# EasyEDA Pro project 智能视觉母版_2024.eprj, board PCB1 (continued)
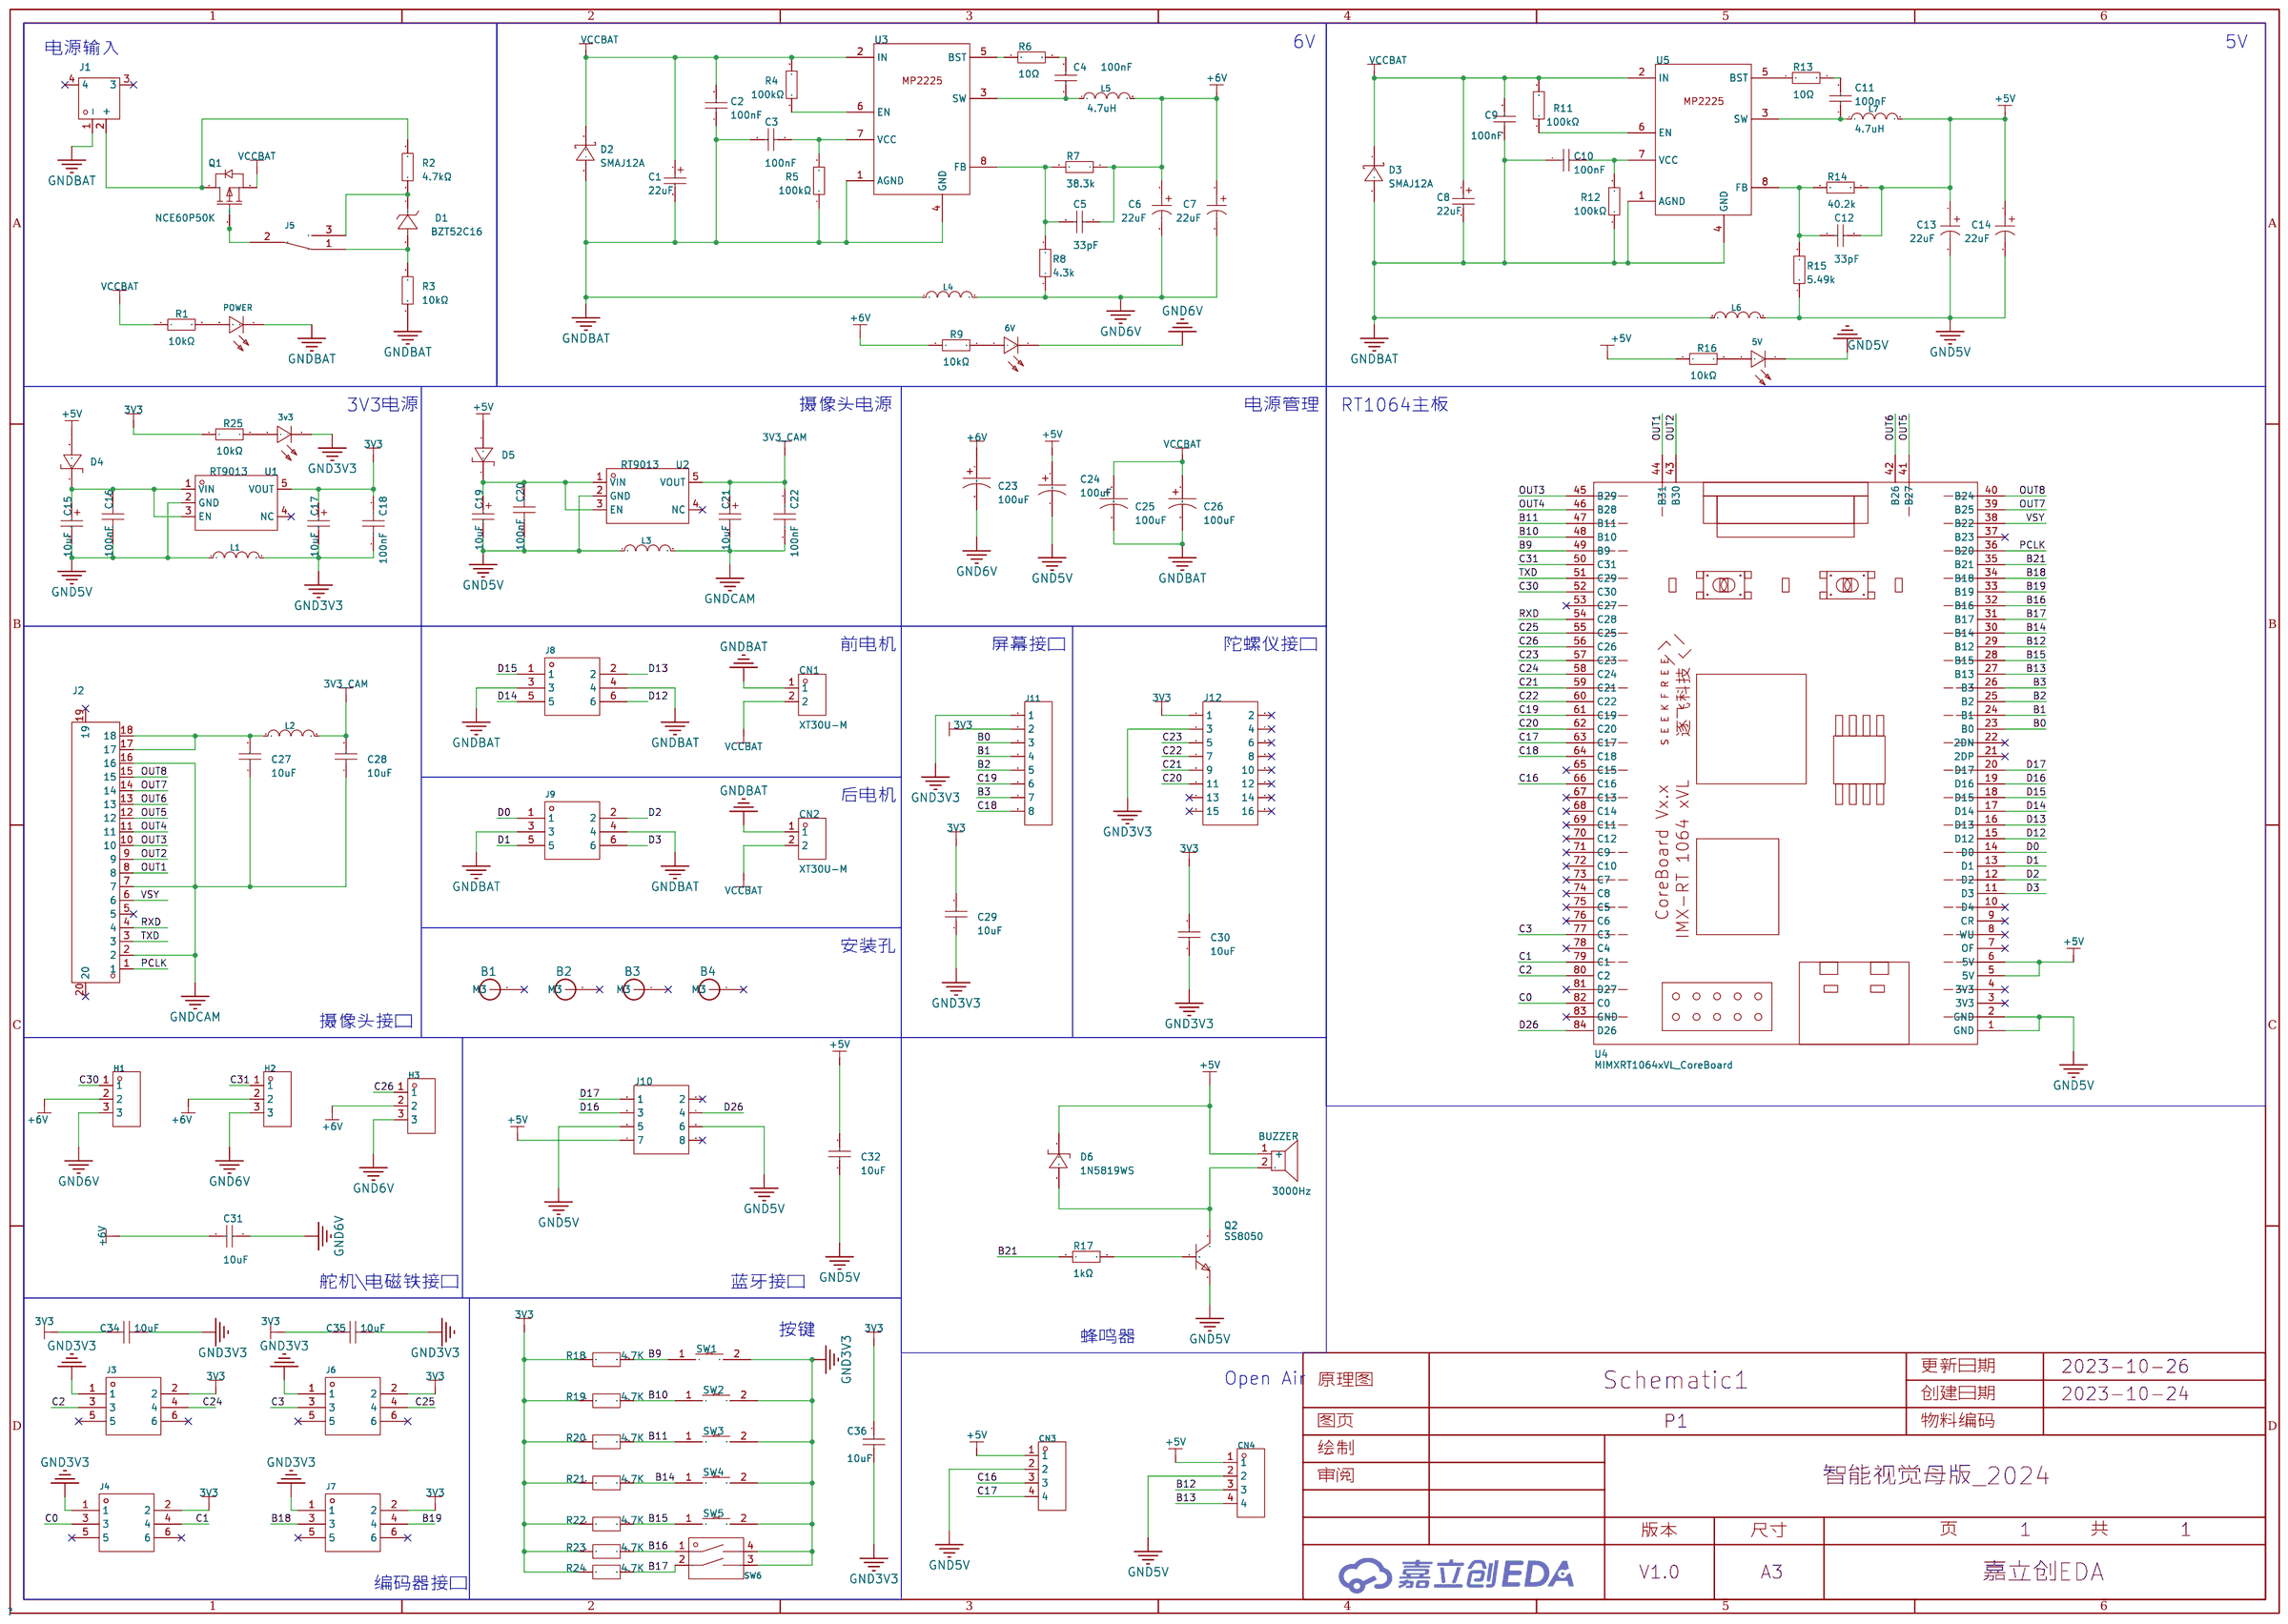
[diagram p0: schematic sheet]
## Routing (per net, layer and track width the routed paths; a pad name or vN(x,y) marks a point on that pad's centre or on a via; arc(x,y) is an arc through that point)
3V3: length 305.6
  Top Layer w0.152: v1(75.82,67.31) 74.55,68.58 74.55,81.28 74.29,81.53 J3.2 ; C30.2 80.65,51.67 v1(80.65,53.47)
  Top Layer w0.381: J12.1 84.24,51.55 C30.2 79.1,51.55 77.22,49.66 77.22,36.32 76.71,35.81 38.3,35.81 J11.2 ; C17.1 16.01,45.21 v1(20.32,45.21) ; C17.1 16.64,43.55 R25.1 ; C17.1 13.79,42.99 C18.2 12.12,43.24 U1.5 ; J3.2 72.9,81.53 64.64,73.28 C35.2 58.93,75.53 58.93,80.26 J6.2 ; C29.2 34.56,36.43 v1(33.02,37.97) 32.13,37.97 31.75,37.59 31.75,28.83 37.97,22.61 37.97,11.83 C34.2 37.08,10.91 J7.2 35.05,4.79 35.05,1.52 35.94,0.63 68.45,0.63 69.6,1.78 69.6,5.55 J4.2
  Top Layer w0.508: C29.2 37.39,36.43 J11.2
  Bottom Layer w0.152: v1(80.65,53.47) 80.65,62.48 v1(75.82,67.31)
  Bottom Layer w0.381: R21.2 88.65,8.01 88.65,7.36 88.53,7.24 86.7,7.24 ; R21.2 90.48,8.64 91.88,7.24 96.01,7.24 96.52,7.75 R18.2 ; R21.2 89.66,9.03 89.66,14.91 R20.2 89.65,19.06 85.35,23.36 R24.2 83.42,23.38 80.77,23.38 ; v1(20.32,45.21) 25.78,45.21 v1(33.02,37.97) ; R19.2 89.65,4.29 86.7,7.24 ; 86.7,7.24 82.29,7.24 R22.2 80.41,9.12 80.41,14.99 C36.2 79.9,15.49 77.34,15.49 76.58,14.73 74.93,14.73 68.33,8.13 J4.2
3V3_CAM: length 46.7
  Top Layer w0.381: v1(18.67,75.31) 19.05,74.93 50.13,74.93 C21.1 51.32,72.5 C22.2 49.48,72.81 U2.5
  Top Layer w0.508: L2.2 v1(15.08,78.1) 16.06,77.12 C28.2
  Bottom Layer w0.381: v1(15.08,78.1) 16.77,78.1 17.14,77.72 17.14,76.83 v1(18.67,75.31)
+5V: length 171.3
  Top Layer w0.381: v1(19.18,37.47) 18.54,37.47 15.24,34.16 C24.1 9.81,37.85 5.23,37.85 2.77,40.3 D4.2 ; R16.1 24.59,50.96 23.11,49.48 20.38,49.48 ; R16.1 26.26,51.82 27.69,51.82 28.07,51.44 28.07,45.85 26.8,44.58 23.24,44.58 22.39,43.73 D6.1 23.5,41.82 23.5,37.51 BUZZER.1 ; R16.1 25.41,57.92 27.69,60.2 33.78,60.2 34.54,59.44 C32.2 ; 20.38,49.48 20.95,50.05 R14.1 22.54,52.2 C12.1 ; 20.38,49.48 17.06,49.48 L7.2 ; C32.2 35.17,57.77 36.96,59.56 41.81,59.56 U4.5 U4.6 45.95,59.79 46.35,60.2 v1(46.35,65.79) 44.84,67.3 CN4.1 34.8,68.25 34.8,69.85 35.78,70.83 D5.2 ; C32.2 32.16,57.77 J10.7
  Bottom Layer w0.381: v1(19.18,37.47) 19.69,36.96 BUZZER.1 ; CN3.1 89.27,69.22 87.91,70.59 71.94,70.59 67.13,65.79 v1(46.35,65.79)
+6V: length 97.7
  Top Layer w0.381: C7.1 C6.1 19.44,65.4 R7.1 19.33,67.21 17.57,67.21 15.49,65.13 ; C7.1 23.5,65.22 22.73,65.98 C5.1 ; C7.1 25.15,64.01 25.78,63.37 25.78,59.18 24,57.4 v1(24,55.12) ; v1(10.67,36.07) 4.19,36.07 2.82,34.7 C23.1
  Top Layer w0.508: 18.45,71.88 17.4,71.88 15.11,74.17 C31.2 9.72,75.44 8.2,75.44 H1.2 ; 18.45,71.88 19.6,70.74 23.5,70.74 24.51,69.72 24.51,68.45 24,67.94 23.26,67.94 C5.1 ; 18.45,71.88 R9.1 ; H2.2 H1.2 ; H1.2 6.6,80.19 6.6,82.68 4.95,84.33 H3.2
  Bottom Layer w0.381: v1(24,55.12) 24,50.42 10.67,37.08 v1(10.67,36.07)
GND3V3: length 309.3
  Top Layer w0.152: J3.1 73.28,68.58 v1(75.44,66.42)
  Top Layer w0.381: SW3.2 SW4.2 92.96,8.45 SW1.2 96.52,3.56 95.63,2.67 SW2.2 90.99,4.64 v1(83.79,4.64) SW5.2 ; J6.1 57.66,74.8 C35.1 60.96,71.5 65.79,71.5 J3.1 ; v1(32.77,34.8) 32.77,28.96 38.74,22.99 38.74,13.59 39.99,12.34 C34.1 39.99,11.03 38.35,9.4 38.35,5.46 37.17,4.28 J7.1 37.08,2.16 38.1,1.14 66.04,1.14 66.42,1.52 v1(66.42,2.87) 66.42,3.35 67.35,4.28 J4.1 ; L1.2 11.81,39.37 12.32,39.88 12.32,41.54 C18.1 13.91,41.59 C17.2 15.97,41.15 3v3.1 ; J12.3 83.73,49.55 C30.1 v1(78.88,49.55) 78.1,48.77 78.1,34.29 76.76,32.95 38.63,32.95 J11.1
  Top Layer w0.508: J11.1 37.14,34.43 C29.1 33.13,34.43 v1(32.77,34.8) ; 3v3.1 v1(18.88,40)
  Bottom Layer w0.152: v1(78.88,49.55) 78.99,49.66 78.99,62.86 v1(75.44,66.42)
  Bottom Layer w0.381: v1(66.42,2.87) 66.42,7.24 74.68,15.49 76.33,15.49 77.85,17.02 78.64,17.02 ; 78.64,17.02 80.38,17.02 C36.1 ; 78.64,17.02 78.99,17.37 78.99,25.43 80.23,26.67 SW6.4 SW6.3 ; J4.1 68.75,4.28 70.61,2.41 81.91,2.41 83.79,4.29 v1(83.79,4.64)
  Bottom Layer w0.508: v1(18.88,40) 29.21,40 32.77,36.45 v1(32.77,34.8)
GND5V: length 161
  Top Layer w0.381: v1(48.47,64.87) 48.47,66.56 L3.1 44.7,68.83 44.45,69.09 C20.1 ; v1(19.05,50.29) 20.19,51.44 20.19,53.09 R15.1 ; C16.1 7.5,42.29 U1.2 ; C16.1 6.68,40.17 7.48,39.37 8.62,40.51 v1(11.05,40.51) ; C16.1 6.05,40.84 C15.2 ; C20.1 44,70.72 C19.2 ; C20.1 45.14,71.86 U2.2 ; v1(15.24,35.81) 12.7,35.81 10.92,37.59 v1(10.92,38.48) ; 29.46,55.39 34.16,55.39 C32.1 35.96,55.77 37.72,57.53 v1(37.72,58.29)
  Top Layer w0.508: 30.84,43.75 30.14,44.45 v1(29.59,44.45) ; v1(26.92,46.36) 26.5,46.78 24.94,46.78 ; L6.2 v1(19.08,46.78) C13.2 C14.2 ; C24.2 17.91,34.16 20.19,36.45 20.19,43.86 C14.2 ; C14.2 24.94,46.78 ; 24.94,46.78 25.36,47.2 5V.1
  Bottom Layer w0.381: v1(15.24,35.81) 16.89,34.16 C24.2 ; v1(10.92,38.48) 10.92,38.99 11.48,39.55 11.48,40.09 v1(11.05,40.51) ; v1(26.92,46.36) 26.92,52.85 29.46,55.39 ; CN3.2 86.77,68.55 85.22,70.1 72.14,70.1 66.9,64.87 v1(49.1,64.87) v1(48.47,64.87) U4.2 U4.1 38.96,64.87 37.72,63.63 ; 37.72,63.63 35.18,63.63 33.25,65.55 CN4.2 ; 37.72,63.63 v1(37.72,58.29) ; v1(19.05,50.29) 19.05,46.81 v1(19.08,46.78)
  Bottom Layer w0.508: v1(26.92,46.36) 28.83,44.45 v1(29.59,44.45)
GND6V: length 100.7
  Top Layer w0.381: v1(20.89,69.98) R8.1 19.88,70.1 17.65,70.1 14.86,72.9 10.26,72.9 C31.1 ; v1(18.54,56.52) 18.54,59.02 C6.2 ; C6.2 19.79,62.35 L4.2 ; C6.2 C7.2 ; v1(24.26,65.91) 25.53,67.18 25.53,69.86 23.41,71.99 ; C23.2 9.27,34.16 v1(9.91,34.8)
  Top Layer w0.508: H2.3 H1.3 ; H2.3 0.55,79.93 0.55,75.06 1.44,74.17 C31.1 ; H2.3 1.78,84.07 H3.3
  Bottom Layer w0.381: v1(20.89,69.98) 21.27,70.36 23.88,70.36 24.26,69.98 v1(24.26,65.91) 23.37,65.02 20.19,65.02 19.18,64.01 v1(19.18,62.36) ; v1(18.54,56.52) 9.91,47.88 v1(9.91,34.8)
GNDBAT: length 285.1
  Top Layer w0.381: J8.4 J8.3 ; U5.4 7.94,53.92 7.75,53.72 ; v1(10.54,54.99) 10.86,54.67 U5.1 ; D3.2 6.73,51.11 v1(6.73,52.07) ; C2.1 v1(11.2,62.04) 12.1,62.04 C3.2 13.99,61.95 14.1,61.84 15.8,61.84 L4.1 ; v1(8.38,69.22) 8.38,68.88 U3.4 ; U3.1 10.82,69.32 v1(10.54,69.6) ; v1(24.01,6.6) 33.02,6.6 v1(34.93,8.51) ; J9.4 J9.3 ; v1(6.48,66.8) D2.2
  Top Layer w0.508: 34.67,47.5 34.29,47.88 v1(32.64,47.88) ; v1(29.84,72.9) 26.8,69.85 v1(26.8,61.72) ; 11.93,47.18 13.66,47.18 R12.1 15.3,47.13 L6.1 ; 11.93,47.18 C9.1 10.16,46.37 v1(9,45.21) ; 11.93,47.18 C10.1 ; v1(53.97,12.06) v1(53.97,16) ; v1(54.86,12.06) v1(54.86,16)
  Top Layer w0.762: D2.2 5.75,64.48 C1.2 v1(2.77,62.48) ; C8.2 5.62,50 D3.2 ; v1(24.01,6.6) 24.01,8.13 25.53,9.65 28.28,9.65 32.63,14.01 POWER.1
  Bottom Layer w0.152: v1(39.88,48.13) 38.74,49.28 38.74,49.78 37.97,50.55 v1(36.96,50.55) ; v1(39.37,43.18) v1(39.37,45.11) v1(39.37,46.48)
  Bottom Layer w0.381: v1(5.72,45.21) 5.08,45.85 5.08,50.42 v1(6.73,52.07) 6.73,52.62 v1(7.78,53.66) 7.75,53.69 7.75,54.74 8,54.99 v1(10.54,54.99) ; v1(10.54,69.6) 10.29,69.85 8.76,69.85 8.38,69.47 v1(8.38,69.22) 6.48,67.31 v1(6.48,66.8) ; v1(34.93,8.51) 54.86,8.51 55.37,8 J9.4
  Bottom Layer w0.508: v1(50.29,16.38) 48.9,14.99 v1(44.96,14.99) ; v1(55.75,36.96) v1(55.75,34.29) v1(55.75,31.88) ; v1(56.42,36.96) v1(56.42,34.27) v1(56.42,31.88) 56.42,30.06 v1(60.78,25.71) 61.21,25.27 63.37,25.27 v1(63.88,25.78) ; v1(29.84,72.9) 30.61,73.66 30.61,76.33 32.41,78.13 CN1.1 35.46,76.07 43.94,76.07 44.83,76.96 44.83,78.99 J8.3 ; v1(26.8,61.72) 24.64,59.56 11.41,59.56 v1(10.66,60.31) ; v1(55.6,51.82) 55.6,49.81 v1(55.63,49.78) ; v1(45.47,2.41) v1(45.47,5.59) ; v1(54.74,51.82) v1(54.74,49.78) ; v1(55.19,56.77) v1(55.19,54.48) ; v1(20.98,34.8) v1(20.32,34.8) 19.59,34.8 17.14,37.25 v1(17.14,37.97) ; v1(67.56,74.68) 68.45,73.79 v1(69.98,73.79) ; v1(39.62,56.64) v1(39.62,54.36) ; v1(63.63,85.6) v1(63.63,83.06) ; v1(43.31,63.63) 47.88,63.63 v1(48.39,63.12) 53.85,57.66 v1(53.85,56.77) v1(53.85,54.48) ; v1(55.12,46.61) v1(55.12,44.83) ; v1(64.26,11.56) 65.53,11.56 v1(66.8,12.83) ; v1(89.41,74.42) v1(83.95,74.42) ; v1(55.86,46.61) v1(55.86,44.83) ; v1(45.72,11.18) 44.96,11.94 v1(42.42,11.94) ; v1(70.74,74.3) v1(73.91,74.3) ; v1(64.39,83.06) v1(64.39,85.6) ; v1(54.48,56.77) v1(54.48,54.48)
  Bottom Layer w0.762: v1(6.73,52.07) 5.97,52.07 5.46,52.58 5.46,58.04 6.6,59.18 ; 6.6,59.18 v1(9.53,59.18) v1(10.14,59.8) v1(10.66,60.31) 11.18,60.83 11.18,61.98 ; 6.6,59.18 4.57,59.18 2.77,60.98 v1(2.77,62.48)
  vias: v1(5.59,17.27) v1(5.59,11.56) v1(5.72,15.24) v1(5.72,6.22) v1(6.23,11.56) v1(6.38,45.21) v1(6.41,17.27) v1(6.43,6.22) v1(6.48,15.24) v1(6.79,11.56) v1(7.04,45.21) v1(7.12,15.24) v1(7.06,6.22) v1(7.19,17.27) v1(7.41,11.56) v1(7.68,45.21) v1(7.68,6.22) v1(7.77,15.24) v1(7.87,17.27) v1(8.34,45.21) v1(10.39,6.22) v1(10.98,6.22) v1(14.52,2.62) v1(14.48,1.91) v1(15.24,2.54) v1(15.3,1.91) v1(17.4,1.27) v1(18.03,1.27) v1(19.56,4.7) v1(19.56,3.94) v1(19.56,2.29) v1(20.25,4.7) v1(20.3,3.94) v1(20.31,2.29) v1(22.73,6.6) v1(23.39,6.6) v1(46.24,2.41) v1(47.04,2.39) v1(47.78,2.39) v1(50.29,17.67) v1(52.45,2.29) v1(53.77,2.29) v1(54.86,2.29) v1(55.65,2.29) v1(56.54,2.29) v1(61.59,11.68) v1(62.29,11.68) v1(63.25,11.68) v1(64.58,25.78) v1(65.28,25.78) v1(75.82,6.1) v1(75.82,5.06) v1(75.82,3.73) v1(93.6,25.61) v1(93.6,24.68) v1(93.6,23.74) v1(93.6,22.9) v1(93.6,22.08) v1(93.6,21.21) v1(93.6,20.45) v1(96.27,70.65) v1(96.27,69.22) v1(96.27,68.14) v1(96.27,67.13) v1(96.27,66.31) v1(96.27,65.41) v1(96.27,64.52) v1(96.39,46.31) v1(96.39,45.59) v1(96.39,44.77) v1(96.39,43.84) v1(96.39,43.1) v1(96.39,42.2) v1(96.39,41.41) v1(96.39,40.64) v1(96.39,39.88) v1(96.39,39.12)
GNDCAM: length 67.8
  Top Layer w0.152: J2.16 19.41,81.45 19.99,82.04 23.5,82.04 23.88,81.66 23.88,80.78 J2.7 23.91,81.56 24.38,82.04 26.03,82.04 26.42,81.66 26.42,80.76 J2.2
  Top Layer w0.381: 17.14,75.31 19.41,77.57 J2.16 ; 17.14,75.31 18.03,74.42 37.34,74.42 v1(39.75,72.01) ; 17.14,75.31 14.73,75.31 14.06,75.98 C28.1 ; C21.2 51.57,71.1 C22.1 49.78,70.49 v1(49.13,69.84) L3.2
  Top Layer w0.508: C28.1 13.33,76.83 12.57,77.6 12.57,82.12 C27.1
  Bottom Layer w0.381: v1(49.13,69.84) 49,69.98 47.24,69.98 45.21,72.01 v1(39.75,72.01)
VCCBAT: length 106.7
  Top Layer w0.381: D3.1 6.48,55.06 6.48,53.59 7.11,52.96 9.93,52.96 10.21,53.24 U5.2 ; U3.2 10.17,67.7 9.91,67.44 7.74,67.44 6.48,68.71 D2.1
  Top Layer w0.508: C9.2 10.11,48.63 R11.2 5.58,48.63 4.57,47.62 v1(3.58,47.62) ; C1.1 2.77,71.99 v1(3.3,72.52) 5.59,72.52 v1(6.35,73.28)
  Top Layer w0.762: 0.76,61.87 0.76,68.83 2.33,70.4 C1.1 5.75,70.4 D2.1 ; 0.76,61.87 1.67,60.96 4.83,60.96 7.24,63.37 8.41,63.37 R4.2 10.25,63.47 C2.2 ; 0.76,61.87 0.76,57.93 C8.1 ; v1(13.21,26.67) 13.46,26.92 13.97,26.92 ; 13.97,26.92 14.61,26.92 v1(14.86,26.67) ; 13.97,26.92 19.18,32.13 26.54,32.13 27.43,31.25 27.43,27.31 28.44,26.29 30.86,26.29 v1(32.25,24.9) v1(32.77,24.38) v1(32.77,23.65) 32.77,16.95 R1.1 ; 13.97,26.92 v1(13.97,26.67) ; C8.1 1.94,55.92 0.89,54.86 0.89,48.64 v1(1.91,47.62) ; C8.1 5.62,55.92 D3.1
  vias: v1(1.91,46.74) v1(2.03,38.1) v1(2.03,27.69) v1(2.03,26.92) v1(2.03,25.15) v1(2.08,37.27) v1(2.71,47.62) v1(2.74,46.74) v1(2.79,38.1) v1(2.83,37.27) v1(2.81,27.69) v1(2.89,26.92) v1(2.86,25.15) v1(3.53,27.69) v1(3.56,46.74) v1(3.71,38.06) v1(3.72,37.27) v1(3.72,26.92) v1(3.69,25.15) v1(6.86,72.77) v1(27.31,7.49) v1(28,7.49) v1(28.74,7.49) v1(29.5,7.49) v1(29.84,9.65) v1(30.26,7.49) v1(30.61,9.65) v1(30.86,22.48) v1(30.86,21.72) v1(30.86,20.84) v1(30.86,19.91) v1(30.86,19.18) v1(30.86,18.42) v1(30.93,7.49) v1(31.5,9.65)
B0: length 5.4
  Top Layer w0.152: J11.3 39.72,36.93 U4.23
B1: length 9
  Top Layer w0.152: U4.24 43.28,38.23 40.97,38.23 J11.4
B2: length 12
  Bottom Layer w0.152: U4.25 41.43,34.39 40.26,35.56 40.26,41.47 J11.5
B3: length 18.7
  Bottom Layer w0.152: J11.7 40.77,46.05 40.77,41.66 41.66,40.77 42.42,40.77 43.31,39.88 43.31,34.92 43.84,34.39 U4.26
B9: length 34.5
  Top Layer w0.152: v1(88.52,16.89) 94.74,16.89 96.52,15.11 SW1.1 ; v1(76.71,21.46) 77.09,21.84 77.85,21.84 79.63,20.07 79.63,18.16 80.14,17.65 v1(80.9,17.65)
  Top Layer w0.381: v1(96.52,11.05) SW1.1
  Bottom Layer w0.152: v1(88.52,16.89) 87.76,17.65 v1(80.9,17.65) ; U4.49 73.63,20.57 76.07,20.57 76.71,21.21 v1(76.71,21.46)
  Bottom Layer w0.381: R18.1 v1(96.52,11.05)
B10: length 26.7
  Top Layer w0.381: v1(86.61,2.67) SW2.1 80.14,2.67 77.72,5.08 77.72,16.49 U4.48
  Bottom Layer w0.381: v1(86.61,2.67) 88.02,2.67 R19.1
B11: length 18.3
  Top Layer w0.381: U4.47 73.61,20.24 75.89,20.24 81.15,14.99 SW3.1 86.67,14.99 v1(86.74,14.91)
  Bottom Layer w0.381: R20.1 v1(86.74,14.91)
B12: length 47.9
  Top Layer w0.152: 39.12,60.83 37.21,60.83 30.75,67.29 CN4.3
  Bottom Layer w0.152: v1(39.24,60.83) 40,60.07 40,57.97 36.32,54.29 36.32,33.13 40.14,29.31 U4.29
B13: length 51.4
  Top Layer w0.152: v1(36.32,60.2) 35.56,60.96 34.59,60.96 CN4.4
  Bottom Layer w0.152: U4.27 42.57,31.85 43.05,31.37 43.05,28.7 42.67,28.32 40.77,28.32 35.94,33.15 35.94,54.27 36.32,54.65 v1(36.32,60.2)
B14: length 56.2
  Top Layer w0.152: v1(73.15,11.43) 73.15,12.06 71.09,14.12 66.52,14.12 60.96,19.69 60.96,20.31 53.33,27.94 49.4,27.94 v1(49.02,27.56) ; v1(47.12,29.97) 45.24,29.97 U4.30 ; v1(80.01,6.6) 82.04,8.64 v1(86.61,8.64)
  Top Layer w0.381: 85.08,8.64 SW4.1
  Bottom Layer w0.152: v1(80.01,6.6) 77.98,6.6 v1(73.15,11.43) ; R21.1 v1(86.61,8.64) ; v1(49.02,27.56) 48.31,27.56 48.16,27.71 48.16,29.44 47.62,29.97 v1(47.12,29.97)
B15: length 51.7
  Top Layer w0.152: U4.28 49.81,31.85 v1(50.55,31.11) ; v1(82.04,10.79) 82.55,11.3 82.55,12.06 82.04,12.57 81.47,12.57 SW5.1 80.45,13.59 v1(78.87,13.59) ; v1(55.88,26.29) 55.88,26.16 67.44,14.6 71.25,14.6 72.26,13.59 v1(75.18,13.59)
  Bottom Layer w0.152: v1(82.04,10.79) 81.53,10.29 R22.1 ; v1(50.55,31.11) 50.55,26.92 51.18,26.29 v1(55.88,26.29) ; v1(78.87,13.59) v1(75.18,13.59)
B16: length 54
  Top Layer w0.152: SW6.1 80.77,20.19 78.23,22.73 71.5,22.73 71.25,22.48 71.25,18.16 70.99,17.91 69.34,17.91 68.71,17.27 67.06,17.27 62.48,21.84 61.73,21.84 54.49,29.08 v1(47.5,29.08)
  Bottom Layer w0.152: v1(47.5,29.08) 46.86,28.45 46.86,26.16 46.48,25.78 45.57,25.78 U4.32
  Bottom Layer w0.381: R23.1 SW6.1
B17: length 53.4
  Top Layer w0.152: v1(67.44,18.16) 62.36,23.24 v1(62.36,24.26) ; v1(47.88,24.51) 47.88,25.65 45.72,27.81 43.08,27.81 U4.31 ; SW6.2 81.03,16.76 79.9,16.76 75.97,20.69 72.38,20.69 v1(72.01,20.32)
  Bottom Layer w0.152: v1(67.44,18.16) 67.56,18.16 69.72,20.32 v1(72.01,20.32) ; v1(47.88,24.51) 48.13,24.26 v1(62.36,24.26)
  Bottom Layer w0.381: R24.1 83.44,19.18 SW6.2
B18: length 38.2
  Top Layer w0.152: U4.34 44.58,23.5 v1(43.69,22.61) ; v1(49.4,21.59) 49.4,7.75 44.32,2.67 41.24,2.67 J7.3
  Bottom Layer w0.152: v1(49.4,21.59) 48.64,22.35 46.23,22.35 45.85,21.97 45.85,20.96 45.47,20.57 43.69,20.57 43.18,21.08 43.18,22.1 v1(43.69,22.61)
B19: length 35.8
  Top Layer w0.152: J7.4 48.77,15.96 48.77,26.03 46.74,28.07 41.4,28.07 40.77,27.43 40.77,26.16 42.04,24.89 U4.33
B21: length 40.5
  Top Layer w0.152: v1(39.24,30.99) 38.86,30.61 38.86,23.88 39.5,23.24 39.5,15.75 40,15.24 v1(42.67,15.24) ; R17.1 34.04,40.13 36.19,37.97 37.85,37.97 v1(39.24,36.58)
  Bottom Layer w0.152: v1(42.67,15.24) 43.18,15.75 43.18,20.55 U4.35 ; v1(39.24,36.58) v1(39.24,30.99)
C0: length 65.5
  Top Layer w0.152: v1(68.58,13.59) 69.22,12.95 71.37,12.95 72.01,12.32 72.01,5.42 J4.3 ; v1(68.2,17.91) v1(68.2,26.8)
  Bottom Layer w0.152: v1(68.58,13.59) 68.58,17.53 v1(68.2,17.91) ; v1(68.2,26.8) 68.2,53.21 70.99,56.01 73.15,56.01 73.79,56.64 73.79,61.06 U4.82
C1: length 61.8
  Top Layer w0.152: v1(61.72,17.53) 61.72,16.76 70.87,7.62 J4.4 ; U4.79 71.6,59.79 70.61,58.8 70.61,57.4 v1(69.34,56.13) ; v1(61.72,22.61) 61.72,27.18 v1(61.85,27.31)
  Bottom Layer w0.152: v1(61.72,17.53) v1(61.72,22.61) ; v1(69.34,56.13) 61.85,48.64 v1(61.85,27.31)
C2: length 20.8
  Top Layer w0.152: J3.3 77.09,77.72 77.09,61.47 75.41,59.79 U4.80
C3: length 28.9
  Top Layer w0.152: v1(63.5,68.96) 63.5,62.74 v1(66.93,59.31) ; J6.3 63.5,75.69 v1(63.5,74.55)
  Bottom Layer w0.152: v1(66.93,59.31) 68.99,57.25 U4.77 ; v1(63.5,68.96) v1(63.5,74.55)
C16: length 29
  Top Layer w0.152: U4.66 76.58,43.54 76.58,53.21 84.27,60.91 CN3.3
C17: length 37.7
  Top Layer w0.152: v1(69.6,42.42) 69.6,51.94 71.12,53.47 76.07,53.47 81.77,59.17 CN3.4
  Bottom Layer w0.152: U4.63 71.02,39.47 69.6,40.89 v1(69.6,42.42)
C18: length 42.6
  Top Layer w0.152: J11.8 38.51,50.84 59.65,50.84 69.72,40.77 73.76,40.77 U4.64
C19: length 39.1
  Top Layer w0.152: J11.6 38.51,45.76 62.06,45.76 70.99,36.83 72.41,36.83 U4.61
C20: length 11.5
  Top Layer w0.152: J12.11 84.07,38.86 82.3,40.64 v1(79.5,40.64)
  Bottom Layer w0.152: U4.62 75.79,36.93 v1(79.5,40.64)
C21: length 17.3
  Bottom Layer w0.152: J12.9 82.07,41.4 79.38,38.7 79.38,35.69 76.96,33.27 73.63,33.27 U4.59
C22: length 14.9
  Bottom Layer w0.152: J12.7 79.12,38.81 79.12,35.81 77.7,34.39 U4.60
C23: length 23.5
  Top Layer w0.152: U4.57 72.52,31.37 73.28,30.61 75.82,30.61 78.74,33.53 78.74,40.97 J12.5
C24: length 75.6
  Top Layer w0.152: v1(78.49,31.88) 87.12,31.88 91.06,35.81 91.06,69.47 83.31,77.22 83.31,81.66 81.66,83.31 77.6,83.31 J3.4
  Bottom Layer w0.152: v1(78.49,31.88) 78.46,31.85 U4.58
C25: length 99
  Top Layer w0.152: J6.4 63.12,84.45 82.04,84.45 86.61,79.88 86.61,75.56 92.2,69.98 92.2,35.94 86.87,30.61 78.1,30.61 75.82,28.32 73.51,28.32 U4.55
C26: length 119.9
  Bottom Layer w0.152: U4.56 73.81,28.07 71.5,28.07 66.68,23.24 40.64,23.24 40.26,23.62 40.26,24.64 34.29,30.61 34.29,58.93 32.38,60.83 30.48,60.83 25.65,65.66 25.65,70.74 24.51,71.88 13.97,71.88 12.57,73.28 12.57,80.49 8.36,84.71 7.49,84.71
C30: length 127.7
  Bottom Layer w0.152: U4.52 73.81,22.99 70.87,22.99 61.47,13.59 40.51,13.59 39.88,14.22 39.88,24.51 33.91,30.48 33.91,58.93 32.38,60.45 30.48,60.45 25.27,65.66 25.27,70.74 24.38,71.63 6.59,71.63 5.02,73.19 H1.1
C31: length 129.4
  Bottom Layer w0.152: U4.50 75.06,21.72 74.1,22.67 71.06,22.67 61.59,13.21 40.13,13.21 39.5,13.84 39.5,24.51 33.55,30.45 33.55,58.78 32.26,60.07 30.48,60.07 24.89,65.66 24.89,70.61 24.13,71.37 6.48,71.37 H2.1
D0: length 52.5
  Top Layer w0.152: U4.14 45.24,50.29 49.28,50.29 v1(49.78,49.78) ; J9.1 50.93,6.18 50.93,26.03 v1(49.78,27.18)
  Bottom Layer w0.152: v1(49.78,27.18) v1(49.78,49.78)
D1: length 68.2
  Top Layer w0.152: v1(51.69,51.82) 50.47,51.82 49.83,51.18 40.64,51.18 40.26,51.56 v1(39.62,51.56) ; v1(53.34,27.18) 53.34,26.8 59.06,21.08 59.06,5.42 J9.5 ; U4.13 39.65,49.63 v1(39.24,50.04)
  Bottom Layer w0.152: v1(51.69,51.82) 53.34,50.17 v1(53.34,27.18) ; v1(39.24,50.04) 39.24,51.18 v1(39.62,51.56)
D2: length 51.6
  Top Layer w0.152: v1(51.18,27.18) 52.83,25.53 J9.2 ; U4.12 44.6,52.2 v1(49.28,52.2)
  Bottom Layer w0.152: v1(49.28,52.2) 51.18,50.29 v1(51.18,27.18)
D3: length 57.9
  Top Layer w0.152: J9.6 57.91,21.21 52.45,26.67 v1(52.45,27.18) ; v1(49.28,53.34) 43.05,53.34 42.04,52.32 U4.11
  Bottom Layer w0.152: v1(49.28,53.34) 52.45,50.17 v1(52.45,27.18)
D12: length 45.9
  Top Layer w0.152: U4.15 43.33,48.39 46.23,48.39 46.35,48.51 v1(46.35,49.15) ; 51.18,76.45 50.29,77.34 50.29,81.15 49.02,82.42 48.26,82.42 J8.6 ; v1(46.35,58.04) 53.85,65.53 v1(53.85,68.83)
  Bottom Layer w0.152: v1(51.18,76.45) 53.85,73.79 v1(53.85,68.83) ; v1(46.35,49.15) v1(46.35,58.04)
D13: length 51.5
  Top Layer w0.152: v1(48.13,48.26) 46.97,47.09 U4.16 ; J8.2 43.94,83.19 48.64,83.19 50.55,81.28 50.55,77.85 54.99,73.41 54.99,64.9 v1(48.13,58.04)
  Bottom Layer w0.152: v1(48.13,58.04) v1(48.13,48.26)
D14: length 51.5
  Top Layer w0.152: v1(44.32,43.31) 44.07,43.05 42.29,43.05 42.04,43.31 U4.17 ; v1(45.72,58.67) 52.71,65.66 v1(52.71,68.96) ; J8.5 49.28,78.99 49.91,78.36 49.91,76.45 v1(50.16,76.2)
  Bottom Layer w0.152: v1(44.32,43.31) 43.56,44.07 43.56,45.53 43.75,45.72 45.21,45.72 46.1,46.61 46.1,47.75 45.47,48.39 43.69,48.39 43.31,48.77 43.31,52.45 44.07,53.21 44.83,53.21 45.72,54.1 v1(45.72,58.67) ; v1(50.16,76.2) 52.71,73.66 v1(52.71,68.96)
D15: length 47.6
  Top Layer w0.152: v1(47.24,58.04) 54.61,65.41 54.61,73.41 52.45,75.56 45.72,75.56 J8.1
  Bottom Layer w0.152: v1(47.24,58.04) 47.24,47.22 U4.18
D16: length 16.2
  Top Layer w0.152: U4.19 41.68,42.01 38.23,45.47 36.45,45.47 36.19,45.72 36.19,48.66 J10.3
D17: length 19
  Top Layer w0.152: U4.20 44.58,41.66 43.56,40.64 40.89,40.64 38.61,42.93 36.58,42.93 32,47.5 J10.1
D26: length 51.7
  Top Layer w0.152: U4.84 73.81,63.63 72.01,63.63 69.72,61.34 69.72,59.44 66.17,55.88 39.24,55.88 37.34,53.97 30.59,53.97 J10.4
OUT1: length 147.9
  Top Layer w0.152: v1(78.74,26.16) 78.74,23.62 78.23,23.11 70.87,23.11 69.98,22.22 U4.44 ; v1(26.03,75.82) 23.41,78.45 J2.8
  Bottom Layer w0.152: v1(26.03,75.82) 26.03,73.51 30.41,69.14 43.89,69.14 45.97,67.06 65.02,67.06 67.06,69.09 67.1,69.09 69.77,71.76 90,71.76 92.58,69.17 92.58,36.09 86.85,30.35 80.65,30.35 78.74,28.45 v1(78.74,26.16)
OUT2: length 151
  Top Layer w0.152: J2.9 22.91,78.19 v1(25.27,75.82)
  Bottom Layer w0.152: v1(25.27,75.82) 25.27,73.91 30.35,68.83 43.81,68.83 45.85,66.8 65.17,66.8 69.87,71.5 89.89,71.5 92.33,69.07 92.33,36.2 86.87,30.73 80.62,30.73 78.16,28.27 78.16,19.61 76.2,17.65 74.29,17.65 73.79,17.15 73.79,16.38 72.9,15.49 70.36,15.49 69.98,15.88 U4.43
OUT3: length 146.9
  Top Layer w0.152: J2.10 22.41,77.92 v1(24.51,75.82)
  Bottom Layer w0.152: v1(24.51,75.82) 24.51,74.3 30.23,68.58 43.69,68.58 45.72,66.55 65.28,66.55 69.98,71.25 89.79,71.25 92.07,68.96 92.07,36.32 86.87,31.11 80.65,31.11 77.6,28.07 77.6,19.43 76.2,18.03 73.15,18.03 72.52,17.4 U4.45
OUT4: length 102.3
  Top Layer w0.152: v1(23.75,75.82) 21.91,77.66 J2.11 ; v1(39.75,28.32) 54.74,28.32 67.82,15.24 73.69,15.24 U4.46
  Bottom Layer w0.152: v1(39.75,28.32) 39.37,28.32 35.56,32.13 35.56,59.45 32.91,62.11 31.24,62.11 26.93,66.42 26.93,71.44 23.75,74.61 v1(23.75,75.82)
OUT5: length 76.5
  Top Layer w0.152: J2.12 21.41,77.4 v1(22.99,75.82) ; v1(47.24,24) 47.24,19.28 U4.41
  Bottom Layer w0.152: 31.11,61.85 26.67,66.29 26.67,71.33 22.99,75.01 v1(22.99,75.82) ; v1(47.24,24) 45.85,25.4 43.81,25.4 43.43,25.78 43.43,27.05 42.67,27.81 40.89,27.81 40.77,27.69 39.6,27.69 35.31,31.98 35.31,59.35 32.81,61.85 31.12,61.85
OUT6: length 78
  Top Layer w0.152: U4.42 45.95,17.78 43.94,17.78 43.05,18.67 43.05,25.25 42.9,25.4 v1(42.8,25.4) ; J2.13 20.91,77.14 v1(22.22,75.82)
  Bottom Layer w0.152: v1(42.8,25.4) 41.88,25.4 39.85,27.43 39.5,27.43 35.05,31.88 35.05,59.24 32.7,61.6 30.99,61.6 26.42,66.17 26.42,71.22 22.22,75.42 v1(22.22,75.82)
OUT7: length 74.8
  Top Layer w0.152: U4.39 41.05,16.61 39.88,17.78 39.88,26.54 v1(39.62,26.8) ; J2.14 20.41,76.88 v1(21.46,75.82)
  Bottom Layer w0.152: v1(21.46,75.82) 21.46,75.65 26.16,70.95 26.16,65.91 30.73,61.34 32.6,61.34 34.8,59.14 34.8,31.62 v1(39.62,26.8)
OUT8: length 76.9
  Top Layer w0.152: v1(40.77,24.89) 40.77,18.16 41.02,17.91 43.28,17.91 U4.40 ; J2.15 19.91,76.61 v1(20.7,75.82)
  Bottom Layer w0.152: v1(20.7,75.82) 20.71,75.82 24.39,72.14 24.62,72.14 25.91,70.84 25.91,65.76 30.59,61.09 32.49,61.09 34.54,59.03 34.54,31.11 v1(40.77,24.89)
PCLK: length 70.3
  Top Layer w0.152: U4.36 44.58,22.1 45.72,23.24 45.72,26.03 v1(46.1,26.42) ; v1(29.08,75.82) 26.91,78 J2.1 ; v1(40,61.34) 39.6,61.34 34.42,66.52 34.42,68.07 30.73,71.75 v1(29.84,71.75)
  Bottom Layer w0.152: v1(40,61.34) 40.39,60.96 40.39,49.15 41.28,48.26 42.42,48.26 43.05,47.62 43.05,41.15 43.56,40.64 45.34,40.64 46.35,39.62 46.35,26.67 v1(46.1,26.42) ; v1(29.84,71.75) 29.08,72.52 v1(29.08,75.82)
RXD: length 135.1
  Top Layer w0.152: U4.54 75.46,27.18 78.49,27.18 79.88,28.58 v1(80.39,28.58) ; J2.4 25.41,77.97 v1(27.56,75.82)
  Bottom Layer w0.152: v1(27.56,75.82) 27.56,72.71 30.62,69.65 44.1,69.65 46.18,67.57 64.81,67.57 66.84,69.6 66.89,69.6 69.56,72.26 90.21,72.26 93.09,69.38 93.09,35.94 93.09,35.94 93.09,35.88 86.55,29.34 81.79,29.34 81.03,28.58 v1(80.39,28.58)
TXD: length 138.9
  Top Layer w0.152: J2.3 25.91,78.23 v1(28.32,75.82) ; U4.51 72.52,24.26 73.66,25.4 77.22,25.4 79.13,27.31 v1(79.5,27.31)
  Bottom Layer w0.152: v1(79.5,27.31) 80.21,28.01 80.82,28.01 81.89,29.08 86.66,29.08 93.35,35.77 93.35,69.49 90.32,72.52 69.45,72.52 66.78,69.85 66.74,69.85 64.74,67.85 46.26,67.85 44.21,69.9 44.15,69.9 44.14,69.9 30.72,69.9 28.32,72.31 v1(28.32,75.82)
VSY: length 170.9
  Top Layer w0.152: v1(46.99,25.27) 46.35,24.64 46.35,20.93 U4.38 ; v1(26.8,75.82) 24.41,78.21 J2.6 ; v1(81.28,29.72) 80.52,29.72 78.74,27.94 61.59,27.94 v1(59.31,25.65)
  Bottom Layer w0.152: v1(26.8,75.82) 26.8,73.11 30.51,69.4 43.99,69.4 46.08,67.31 64.92,67.31 66.95,69.34 66.99,69.34 69.66,72.01 90.04,72.01 90.05,72.01 90.1,72.01 92.84,69.28 92.84,35.98 86.57,29.72 v1(81.28,29.72) ; v1(46.99,25.27) 47.37,25.65 v1(59.31,25.65)
$1N2017: length 13
  Top Layer w0.762: D1.1 R2.1 23,14.74 23.5,15.24 23.5,20.7 24.13,21.34 25.65,21.34 25.91,21.59
$1N2018: length 8.1
  Top Layer w0.762: R3.1 D1.2 22.72,12.19 J5.1
$1N2019: length 9.1
  Top Layer w0.762: Q1.3 20.45,24.16 R2.2
$1N2020: length 19.1
  Top Layer w0.762: Q1.1 21.26,28.78 23.62,26.42 23.62,23.24 23.75,23.11 27.69,23.11 28.32,22.48 28.32,18.92 26.29,16.89 J5.2
$1N2023: length 1.8
  Top Layer w0.762: R1.2 31.08,14.98 POWER.2
$1N2720: length 9.8
  Top Layer w0.381: R11.1 8.38,46.74 7.87,46.23 v1(6.73,46.23) ; v1(9.14,50.29) 9.56,50.71 U5.6
  Bottom Layer w0.381: v1(9.14,50.29) 8.13,50.29 6.1,48.26 6.1,46.86 v1(6.73,46.23)
$1N2721: length 10.1
  Top Layer w0.381: L7.1 13.87,56.77 9.78,56.77 C11.1 9.08,55.18 9.53,54.74 9.53,53.95 U5.3
$1N2725: length 1.8
  Top Layer w0.381: 5V.2 26.92,49.19 R16.2
$1N2726: length 5.4
  Top Layer w0.381: R12.2 13.67,48.59 11.94,48.59 11.94,49.02 10.21,50.75 U5.7
$1N2727: length 7.1
  Top Layer w0.381: U5.5 8.91,52.09 9.27,52.45 11.18,52.45 11.68,52.96 11.68,55.12 R13.1
$1N2728: length 1.7
  Top Layer w0.508: 9.08,57.47 10.75,57.47 10.8,57.51
$1N2730: length 16
  Top Layer w0.381: C12.2 22.73,54.61 22.22,55.12 20.71,55.12 R15.2 R14.2 18.03,52.2 17.27,52.96 12.7,52.96 11.24,51.49 U5.8
$1N3433: length 9.9
  Top Layer w0.381: U3.3 9.52,69.46 9.08,69.89 C4.1 9.78,71.25 13.48,71.25 L5.1
$1N3437: length 1.7
  Top Layer w0.508: 6V.2 21.8,71.98 R9.2
$1N3439: length 8.2
  Top Layer w0.381: R4.1 7.75,61.21 v1(7.24,61.21) ; U3.6 9.52,65.27 v1(9.02,64.77)
  Bottom Layer w0.381: v1(7.24,61.21) 6.98,61.47 6.98,64.01 7.75,64.77 v1(9.02,64.77)
$1N3441: length 5.9
  Top Layer w0.381: U3.7 10.17,65.17 10.95,64.39 11.81,64.39 12.19,64.01 C3.1 14.09,63.35 R5.2
$1N3443: length 14.8
  Top Layer w0.381: C5.2 21.24,67.32 R7.2 20.82,67.32 19.38,68.75 R8.2 19.05,69.09 17.65,67.69 12.53,67.69 U3.8
$1N3444: length 2
  Top Layer w0.381: R6.2 10.96,71.95 C4.2
$1N3445: length 6.8
  Top Layer w0.381: R6.1 11.43,70.08 11.43,67.37 10.97,66.9 10.94,66.93 9.27,66.93 8.87,66.52 U3.5
$1N3714: length 9.8
  Top Layer w0.381: 42.49,73.18 C19.1 ; 42.49,73.18 D5.1 ; 42.49,73.18 43.92,73.18 44.45,72.64 C20.2 45.78,72.57 U2.1 46.95,72.81 47.24,72.52 47.24,71.37 46.74,70.87 46.06,70.87 U2.3
$1N5546: length 9.3
  Top Layer w0.381: U1.3 9.08,41.34 9.27,41.53 9.27,42.8 8.83,43.24 U1.1 7.69,43.24 7.31,42.86 C16.2 6.3,43.24 4.8,43.24 4.7,43.34 D4.1
$1N5812: length 7.4
  Top Layer w0.508: 18.85,80.75 J2.18 17.62,80.75 L2.1 14.39,80.72 C27.2
$1N7643: length 10.9
  Top Layer w0.381: D6.2 25.37,43.56 28.08,43.56 Q2.3 28.84,41.42 27.94,40.51 BUZZER.2
$1N7645: length 1.9
  Top Layer w0.381: R17.2 30.84,40.49 Q2.1
$1N9389: length 1.8
  Top Layer w0.381: R25.2 18.41,42.08 3v3.2

## Copper pours and planes (outline as drawn; the poured copper is in the pictures)
GNDBAT on Top Layer: 13.59,7.37 26.47,7.37 26.47,0.59 13.59,0.59
GNDBAT on Top Layer: -4.44,91.82 106.3,91.82 106.3,-4.7 -4.44,-4.7
GNDBAT on Bottom Layer: 5.08,20.32 9.4,20.32 9.4,45.72 5.08,45.72
GNDBAT on Bottom Layer: -4.44,91.82 106.3,91.82 106.3,-4.7 -4.44,-4.7
GNDBAT on Bottom Layer: 5.08,20.32 5.08,24.64 17.32,24.64 17.32,19.57 14.42,19.57 14.42,22.86 9.53,22.86 9.53,20.38 9.47,20.32
GNDBAT on Bottom Layer: 5.08,23.37 9.4,23.37 9.4,7.49 19.69,7.49 19.69,0.63 13.09,0.63 13.08,0.63 13.08,5.59 5.21,5.59 5.08,5.72
VCCBAT on Top Layer: 1.4,23.11 4.06,23.11 4.06,20.45 13.63,20.45 13.63,18.29 1.52,18.29 1.4,18.41
VCCBAT on Top Layer: 10.97,19.75 10.97,25.08 12.74,25.08 12.74,27.18 15.47,27.18 15.47,23.13 15.49,23.11 13.66,23.11 13.66,19.77 13.64,19.75
VCCBAT on Bottom Layer: 0.76,68.2 0.76,85.85 0.89,85.98 37.97,85.98 37.97,80.45 15.37,80.45 15.37,68.31 15.49,68.18 0.78,68.18
VCCBAT on Bottom Layer: 28.96,25.91 33.78,25.91 33.78,0.95 26.53,0.95 26.53,8.22 28.96,8.22
VCCBAT on Bottom Layer: 1.4,18.03 4.61,18.03 4.61,48.13 1.27,48.13 1.27,18.16
$1N2019 on Top Layer: 13.65,15.74 19.43,15.74 19.43,18.24 22.14,18.24 22.14,15.36 19.44,15.36 19.43,15.37 19.43,9.78 13.59,9.78 13.59,15.68

Small or netless copper shapes (teardrops, artwork), in the pictures only: 518 on Top Layer, 221 on Bottom Layer

## Text on the board
Top Layer: HZCU | 2024 | DEBUG
Top Silkscreen Layer: ON | +
